# EasyEDA Pro project WearableGasDetect.eprj, board PCB1 (continued)
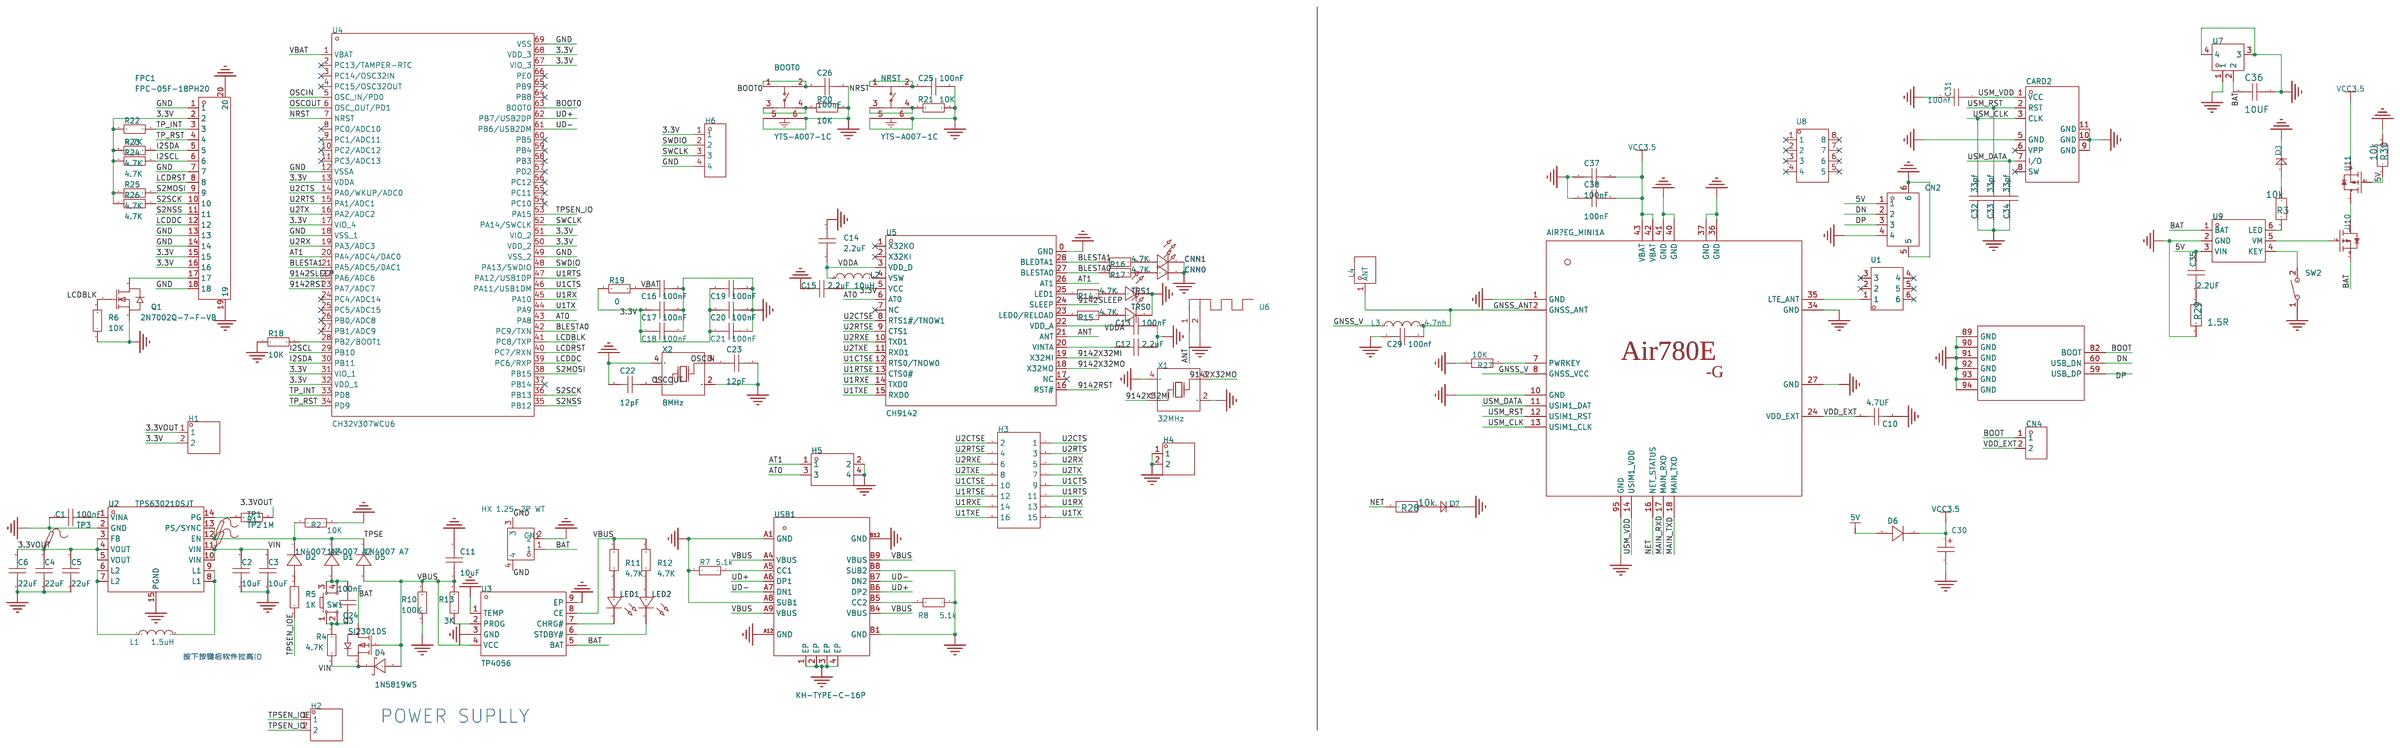
[diagram p0: schematic sheet]
## Footprints (pads in the part's own frame, mm; a bottom-side part is the same pattern mirrored in y, then rotated) (continued)
  rect 0.7x0.2 smd: 8(2,-1.2) 9(2,-0.8) 10(2,-0.4) 11(1.999,0) 12(2,0.4) 13(2,0.8) 14(2,1.2) 22(-2,1.2) 23(-2,0.8) 24(-2,0.4) 25(-2,0) 26(-2,-0.4) 27(-2,-0.8) 28(-2,-1.2)
QFN-68_L8.0-W8.0-P0.40-BL-EP6.7
  rect 0.2x0.8 smd: 1(-3.2,-4) 2(-2.8,-4) 3(-2.4,-4) 4(-2,-4) 5(-1.6,-4) 6(-1.2,-4) 7(-0.8,-4) 8(-0.4,-4) 9(0,-4) 10(0.4,-4) 11(0.8,-4) 12(1.2,-4) 13(1.6,-4) 14(2,-4) 15(2.4,-4) 16(2.8,-4) 17(3.2,-4) 35(3.2,4) 36(2.8,4) 37(2.4,4) 38(2,4) 39(1.6,4) 40(1.2,4) 41(0.8,4) 42(0.4,4) 43(0,4) 44(-0.4,4) 45(-0.8,4) 46(-1.2,4) 47(-1.6,4) 48(-2,4) 49(-2.4,4) 50(-2.8,4) 51(-3.2,4)
  rect 0.8x0.2 smd: 18(4,-3.2) 19(4,-2.8) 20(4,-2.4) 21(4,-2) 22(4,-1.6) 23(4,-1.2) 24(4,-0.8) 25(4,-0.4) 26(4,0) 27(4,0.4) 28(4,0.8) 29(4,1.2) 30(4,1.6) 31(4,2) 32(4,2.4) 33(4,2.8) 34(4,3.2) 52(-4,3.2) 53(-4,2.8) 54(-4,2.4) 55(-4,2) 56(-4,1.6) 57(-4,1.2) 58(-4,0.8) 59(-4,0.4) 60(-4,0) 61(-4,-0.4) 62(-4,-0.8) 63(-4,-1.2) 64(-4,-1.6) 65(-4,-2) 66(-4,-2.4) 67(-4,-2.8) 68(-4,-3.2)
  custom 6.65x6.65 smd: 69(0,0)
R0402
  rect 0.566x0.54 smd: 1(-0.433,0) 2(0.433,0)
R0603
  rect 0.806x0.864 smd: 1(-0.753,0) 2(0.753,0)
r0603
  rect 0.806x0.864 smd: 1(-0.753,0) 2(0.753,0)
SOD-123FL_L2.8-W1.8-LS3.7-RD
  rect 1.2x1.2 smd: 1(-1.6,0) 2(1.6,0)
SOD-123FL_L3.0-W1.8-LS3.7-RD
  rect 1.4x1.219 smd: 1(-1.6,0) 2(1.6,0)
SOD-323_L1.8-W1.3-LS2.5-RD
  rect 1x0.75 smd: 1(-1.173,0) 2(1.173,0)
SOIC-8_L4.9-W3.9-P1.27-LS6.0-BL
  oval 0.588x2.045 smd: 1(-1.905,-2.772) 2(-0.635,-2.772) 3(0.635,-2.772) 4(1.905,-2.772) 5(1.905,2.772) 6(0.635,2.772) 7(-0.635,2.772) 8(-1.905,2.772)
SOT-23-3_L2.9-W1.3-P1.90-LS2.4-BR
  rect 1.25x0.7 smd: 1(1,-0.95) 2(1,0.95) 3(-1,0)
SOT-23-3_L2.9-W1.4-P1.90-LS2.5-BR
  rect 1.07x0.6 smd: 1(1.035,-0.95) 2(1.035,0.95) 3(-1.035,0)
SOT-23-3_L2.9-W1.6-P1.90-LS2.8-BR
  rect 1.07x0.6 smd: 1(1.235,-0.95) 2(1.235,0.95) 3(-1.235,0)
SW-SMD_4P-L6.0-W6.0-P4.50-LS9.0-2
  rect 2.3x1.5 smd: 1(-4.55,2.25) 2(4.55,2.25) 3(-4.55,-2.25) 4(4.55,-2.25)
SW-SMD_6P-L3.4-W3.4-P2.00-LS4.0
  rect 1.1x0.7 smd: 1(-1.95,1) 2(1.95,1) 3(-1.95,-1) 4(1.95,-1)
  rect 0.7x0.25 smd: 5(0,1.625) 6(0,-1.625)
SW-SMD_L6.1-W3.6-LS7.9
  rect 1.5x1 smd: 1(-3.95,0) 2(3.95,0)
Test-Point-0.5mm
  round 0.5 smd: 1(0,0)
USB-C-SMD_KH-TYPE-C-16P
  oval 1x2 hole 0.6x1.7: 1(-4.32,1.765) 2(4.32,1.765)
  oval 1x1.8 hole 0.6x1.4: 3(-4.32,-2.415) 4(4.32,-2.415)
  rect 0.3x1.3 smd: A1(-3.35,2.415) A4(-2.55,2.415) A5(-1.25,2.415) A6(-0.25,2.415) A7(0.25,2.415) A8(1.25,2.415) A9(2.55,2.415) A12(3.35,2.415) B1(3.05,2.415) B4(2.25,2.415) B5(1.75,2.415) B6(0.75,2.415) B7(-0.75,2.415) B8(-1.75,2.415) B9(-2.25,2.415) B12(-3.05,2.415)
VSON-14_L4.0-W3.0-P0.50-BL-EP_TI_DSJ
  rect 0.25x0.7 smd: 1(-1.5,-1.45) 2(-1,-1.45) 3(-0.5,-1.45) 4(0,-1.45) 5(0.5,-1.45) 6(1,-1.45) 7(1.5,-1.45) 8(1.5,1.45) 9(1,1.45) 10(0.5,1.45) 11(0,1.45) 12(-0.5,1.45) 13(-1,1.45) 14(-1.5,1.45)
  custom 4.4x1.58 smd: 15(0,0)
通用蓝牙天线
  rect 0.5x0.5 smd: 1(-10.325,0)
  rect 0.9x0.5 smd: 2(-12.425,0)

## Nets
As in the schematic.

Pads without a net: CARD2 6 8; FPC2 1 2 3 4 5 6 7 8 9 10 11 12 13 14 15 16 17 18 19 20 21 22 23 24 25 26 27 28 29 30 31 32 33 34 35 36; U1 2 3 4 5 6; U4 2 3 4 8 9 10 11 24 25 26 27 37 54 55 56 57 58 59 60 64 65 66; U5 1 2 7 17; U8 1 2 3 4 5 6 7 8; U12 1 2 3 4 5 6 7 8

## Via types
v1: diameter 0.61, hole 0.305, Top Layer to Bottom Layer, 369 vias

## Routing (per net, layer and track width the routed paths; a pad name or vN(x,y) marks a point on that pad's centre or on a via; arc(x,y) is an arc through that point)
3.3V: length 128.2
  Top Layer w0.203: v1(26.08,20.3) 26.08,19.39 24.18,17.48 24.18,17.44 ; 33.58,17.44 33.58,16.3 ; 33.58,17.44 U4.31 ; 33.58,17.44 33.63,17.5 U4.32 ; 33.58,16.3 33.58,16.28 C20.1 33.69,15.84 v1(33.7,15.85) ; 33.58,16.3 33.25,15.97 33.14,15.97 ; 24.18,17.44 26.64,19.9 U4.13 ; 24.18,17.44 C18.1 ; FPC1.15 35.63,10.41 v1(35.93,10.71) 36.13,10.51 FPC1.16 ; C17.1 28.78,26.59 U4.67 28.73,25.55 v1(25.64,25.55) ; v1(25.64,26.79) 25.09,27.34 R19.1 ; U4.17 27.58,17.92 C19.1 27.04,16.81 v1(27.28,16.57) ; C21.1 36.92,25.25 36.94,25.23 ; C21.1 37.26,24.83 v1(37.26,24.43) ; C21.1 36.12,25.25 36.12,25.24 U4.51 U4.50 ; 28.88,10.84 29.13,10.59 FPC1.2 ; C15.2 49.77,33.57 49.2,34.14 48.31,34.14 47.38,35.08 U5.5
  Top Layer w0.381: H1.2 35.28,35.78 35.28,41.57 27.86,48.99 H6.1
  Top Layer w0.508: v1(37.01,33.63) 37.6,33.04 40.4,33.04 43.48,29.95 49.96,29.95 51.36,31.35 51.36,32.68 51.04,33 49.81,33 C15.2
  Bottom Layer w0.203: v1(36.63,33.95) 36.69,33.95 v1(37.01,33.63)
  Bottom Layer w0.508: v1(35.93,10.71) 35.86,10.77 v1(29.01,10.77) 28.37,11.41 28.37,15.54 28.31,15.54 ; 28.31,15.54 28.37,15.47 33.32,15.47 v1(33.7,15.85) ; 28.31,15.54 v1(27.28,16.57) 26.08,17.76 v1(26.08,20.3) 25.64,20.74 v1(25.64,25.55) v1(25.64,26.15) v1(25.64,26.79) 25.64,27.92 27.23,29.51 29.01,29.51 H1.2 ; v1(36.63,33.95) H1.2 ; H1.2 33.45,28.24 v1(37.26,24.43)
3.3VOUT: length 11.2
  Top Layer w0.203: R1.2 v1(19.1,33.76)
  Bottom Layer w0.203: v1(19.1,33.76) 19.92,32.94 28.18,32.94 v1(28.81,33.57)
GND: length 36.6
  Top Layer w0.127: FPC1.7 31.63,8.47 arc(31.64,8.41) 31.67,8.36 arc(31.73,8.07) 31.9,7.82 v1(31.93,7.79) ; 8.45,39.31 7.94,38.8 arc(7.78,38.69) 7.59,38.65 arc(7.43,38.62) USB1.B12 ; 8.45,39.31 v1(8.81,39.67) ; 8.45,39.31 arc(7.92,38.95) USB1.A1 ; v1(26.59,21.19) 26.59,20.98 arc(26.66,20.64) 26.85,20.36 27.42,20.36 arc(27.51,20.35) U4.12 ; FPC1.13 34.63,7.63 arc(34.65,7.51) v1(34.72,7.41) arc(35.02,7.86) 35.13,8.39 FPC1.14 ; USB1.A8 7.69,34.23 arc(8.87,34.46) R8.1 10.53,35.78 10.53,36.75 10.09,37.18 R7.2 arc(9.84,37.21) 9.78,37.23 USB1.B8 6.74,37.23 arc(6.09,37.1) v1(5.54,36.73) ; 7.29,32.13 9.38,32.13 arc(9.52,32.15) v1(9.63,32.23) arc(9.41,32.37) 9.15,32.43 USB1.B1 ; v1(31.04,16.62) 31.04,16.48 R18.1 ; U4.49 arc(34.1,23.6) 32.85,22.77 U4.69 28.94,18.86 arc(28.53,18.24) U4.18
  vias: v1(7.35,5.06) v1(7.4,3.65) v1(7.4,2.26) v1(7.4,0.67) v1(9.05,5.06) v1(9.1,3.65) v1(9.1,2.26) v1(9.1,0.67) v1(10.73,5.06) v1(10.77,3.65) v1(10.77,2.26) v1(10.77,0.67) v1(12.28,5.06) v1(12.33,3.65) v1(12.33,2.26) v1(12.33,0.67) v1(16.69,39.86) v1(17.32,39.86) v1(18.46,39.86) v1(19.1,39.86) v1(19.42,52.37) v1(19.46,50.95) v1(19.46,49.56) v1(19.46,47.98) v1(20.94,40.43) v1(21,34.59) v1(21.12,52.37) v1(21.16,50.95) v1(21.16,49.56) v1(21.16,47.98) v1(21.26,39.86) v1(21.32,34.02) v1(21.58,40.43) v1(21.64,34.59) v1(21.89,39.86) v1(21.96,34.02) v1(22.21,40.43) v1(22.27,34.59) v1(22.53,39.86) v1(22.59,34.02) v1(22.79,52.37) v1(22.84,50.95) v1(22.84,49.56) v1(22.84,47.98) v1(22.85,40.43) v1(22.91,34.59) v1(23.92,14.39) v1(24.34,52.37) v1(24.39,50.95) v1(24.39,49.56) v1(24.39,47.98) v1(25,39.41) v1(25.64,39.41) v1(25.96,9.5) v1(26.47,15.72) v1(26.78,39.41) v1(26.94,6.82) v1(27.08,9.5) v1(27.42,45.64) v1(27.42,39.41) v1(27.46,44.22) v1(27.46,42.83) v1(27.46,41.25) v1(28.56,39.41) v1(29.12,45.64) v1(29.07,23.73) v1(29.11,22.32) v1(29.11,20.92) v1(29.11,19.34) v1(29.07,7.92) v1(29.07,6.89) v1(29.17,44.22) v1(29.17,42.83) v1(29.17,41.25) v1(29.2,39.41) v1(30.77,23.73) v1(30.82,22.32) v1(30.82,20.92) v1(30.82,19.34) v1(30.84,44.22) v1(30.84,42.83) v1(30.84,41.25) v1(31.93,5.24) v1(32.39,42.83) v1(32.39,41.25) v1(32.44,23.73) v1(32.49,22.32) v1(32.49,20.92) v1(32.49,19.34) v1(32.62,26.9) v1(33.14,13.84) v1(34,23.73) v1(34.04,22.32) v1(34.04,20.92) v1(34.04,19.34) v1(35.98,7.41) v1(36.9,12.11) v1(36.95,7.41) v1(37.96,25.25) v1(38.09,9.69) v1(38.21,38.27) v1(38.21,36.84) v1(38.21,8.74) v1(38.78,53.1) v1(38.78,52.25) v1(38.78,51.4) v1(38.78,50.55) v1(38.78,49.7) v1(38.78,48.85) v1(38.78,48) v1(38.78,47.15) v1(38.78,46.3) v1(38.78,45.38) v1(38.75,34.9) v1(39.29,44.81) v1(39.38,9.69) v1(39.48,53.48) v1(39.48,52.63) v1(39.48,51.78) v1(39.48,50.93) v1(39.48,50.08) v1(39.48,49.23) v1(39.48,48.38) v1(39.48,47.53) v1(39.48,46.68) v1(39.58,45.65) v1(39.58,8.84) v1(40.12,53.15) v1(40.12,52.3) v1(40.12,51.45) v1(40.12,50.6) v1(40.12,49.75) v1(40.12,48.91) v1(40.12,48.06) v1(40.12,47.21) v1(40.12,46.36) v1(40.15,45.01) v1(40.53,45.65) v1(40.63,30.97) v1(40.67,9.69) v1(41.01,8.84) v1(41.07,46.36) v1(41.1,45.01) v1(41.32,30.4) v1(41.42,45.62) v1(41.96,46.33) v1(41.99,44.99) v1(42.02,29.82) v1(42.37,45.65) v1(42.91,46.36) v1(42.94,45.01) v1(43.32,45.65) v1(43.86,46.36) v1(43.9,45.01) v1(44.69,46.14) v1(44.69,45.29) v1(44.69,44.44) v1(44.69,43.6) v1(44.69,42.75) v1(44.69,41.9) v1(44.69,41.05) v1(44.69,40.2) v1(45.45,30.97) v1(46.21,38.4) v1(46.2,37.59) v1(46.21,36.75) v1(46.4,46.48) v1(46.4,45.82) v1(46.4,44.97) v1(46.4,44.12) v1(46.4,43.27) v1(46.4,42.42) v1(46.4,41.57) v1(46.98,38.4) v1(46.98,37.59) v1(46.98,36.75) v1(47.29,46.33) v1(47.33,45.06) v1(47.83,45.7) v1(47.83,38.4) v1(47.85,37.59) v1(47.86,36.75) v1(48.25,46.33) v1(48.28,45.06) v1(48.79,45.7) v1(49.2,46.33) v1(49.2,10.2) v1(49.23,45.06) v1(49.24,8.79) v1(49.24,7.4) v1(49.24,5.82) v1(49.74,45.7) v1(50.15,46.33) v1(50.18,45.06) v1(50.69,45.7) v1(50.9,10.2) v1(50.95,8.79) v1(50.95,7.4) v1(50.95,5.82) v1(51.1,46.33) v1(51.14,45.06) v1(51.64,45.7) v1(52.06,46.33) v1(52.09,45.06) v1(52.6,45.7) v1(52.57,10.2) v1(52.62,8.79) v1(52.62,7.4) v1(52.62,5.82) v1(53.01,46.33) v1(53.04,45.06) v1(53.55,45.7) v1(53.96,46.33) v1(53.99,45.06) v1(54.13,10.2) v1(54.17,8.79) v1(54.17,7.4) v1(54.17,5.82) v1(54.5,45.7) v1(54.91,46.33) v1(54.95,45.06) v1(55.45,45.7) v1(55.87,46.33) v1(55.9,45.06) v1(55.93,10.08) v1(55.97,8.66) v1(55.97,7.27) v1(55.97,5.69) v1(56.41,45.7) v1(56.82,46.33) v1(56.85,45.06) v1(57.36,45.7) v1(57.71,43.16) v1(57.63,10.08) v1(57.68,8.66) v1(57.68,7.27) v1(57.68,5.69) v1(57.77,46.33) v1(57.8,45.06) v1(57.75,41.75) v1(57.75,40.36) v1(57.75,38.77) v1(58.31,45.7) v1(58.79,46.33) v1(58.82,45.06) v1(59.3,10.08) v1(59.33,45.7) v1(59.41,43.16) v1(59.35,8.66) v1(59.35,7.27) v1(59.35,5.69) v1(59.45,41.75) v1(59.45,40.36) v1(59.45,38.77) v1(59.74,46.33) v1(59.77,45.06) v1(60.28,45.7) v1(60.69,53.13) v1(60.69,52.28) v1(60.69,51.43) v1(60.69,50.58) v1(60.69,49.73) v1(60.69,48.88) v1(60.69,48.03) v1(60.69,47.18) v1(60.69,46.33) v1(60.69,46.33) v1(60.72,45.06) v1(60.72,45.06) v1(60.86,10.08) v1(60.9,8.66) v1(60.9,7.27) v1(60.9,5.69) v1(61.08,43.16) v1(61.13,41.75) v1(61.13,40.36) v1(61.13,38.77) v1(61.23,45.7) v1(61.23,45.7) v1(61.39,53.64) v1(61.39,52.79) v1(61.39,51.94) v1(61.39,51.09) v1(61.39,50.24) v1(61.39,49.39) v1(61.39,48.54) v1(61.39,47.69) v1(61.39,46.84) v1(61.77,45) v1(62.09,53.19) v1(62.09,52.34) v1(62.09,51.49) v1(62.09,50.64) v1(62.09,49.79) v1(62.09,48.95) v1(62.09,48.1) v1(62.09,47.25) v1(62.09,46.4) v1(62.15,45.64) v1(62.6,45) v1(62.64,43.16) v1(62.68,41.75) v1(62.68,40.36) v1(62.68,38.77) v1(62.79,53.64) v1(62.79,52.79) v1(62.79,51.94) v1(62.79,51.09) v1(62.79,50.24) v1(62.79,49.39) v1(62.79,48.54) v1(62.79,47.69) v1(62.79,46.84) v1(62.85,45.95)
VBAT: length 4.2
  Top Layer w0.203: 26.18,24.39 26.77,24.39 27.08,24.7 U4.1 ; 26.18,24.39 25.64,24.93 25.14,24.93 R19.2 ; 26.18,24.39 C16.1
VBUS: length 80.6
  Top Layer w0.203: USB1.B4 6.5,33.23 6.11,33.62 5.14,33.62 4.38,34.38 4.38,36.89 5.02,37.52 6.34,37.52 6.54,37.73 USB1.B9
  Top Layer w0.305: 11.67,40.94 11.67,40.77 11.54,40.64 ; 11.67,40.94 16.75,40.94 17.08,41.27 17.08,43.9 15.88,45.11 15.88,45.64 ; 11.67,40.94 11.67,43.03 11.03,43.67 11.03,49.7 12.18,50.84 ; 11.67,40.94 11.42,40.94 ; 11.54,40.64 16.87,40.64 17.38,41.15 17.38,44.03 16.18,45.23 16.18,45.64 ; 11.54,40.64 8.63,37.73 ; USB1.B9 8.63,37.73 ; 8.63,37.73 8.63,37.9 8.5,38.03 ; 8.5,38.03 USB1.A4 ; 8.5,38.03 11.42,40.94 ; 11.69,37.42 11.46,37.19 11.46,33.36 11.02,32.93 USB1.A9 ; 11.48,37.63 11.16,37.32 11.16,33.49 10.9,33.23 USB1.B4 ; 11.42,40.94 11.42,42.93 10.78,43.56 10.78,49.8 12,51.02
VDDA: length 26.2
  Top Layer w0.203: 43.58,39.69 C14.1 ; 43.58,39.69 44.44,38.83 U5.22 ; 43.58,39.69 43.44,39.54 37.77,39.54 37.39,39.16 37.39,34.14 37.89,33.63 43.2,33.63 C13.1 45.53,32.97 L2.1 45.95,33.87 46.58,34.5 U5.3
9142RST: length 94.3
  Top Layer w0.203: U5.16 47.78,40.09 47.93,40.24 50.57,40.24 53.06,37.75 54.81,37.75 55.88,36.69 55.88,33.62 62.1,27.4 62.1,20.05 58.52,16.48 45.89,16.48 43.5,14.09 43.5,6.02 40.69,3.22 26.41,3.22 24.42,5.2 24.42,10.02 28.23,13.82 28.23,14.63 30.38,16.78 U4.23
9142SLEEP: length 109.8
  Top Layer w0.203: v1(43.23,38.27) 43.46,38.03 U5.24 ; U4.22 29.98,16.81 27.92,14.76 27.92,13.95 24.11,10.13 24.11,5.07 26.28,2.9 40.82,2.9 43.81,5.89 43.81,13.96 46.02,16.16 58.65,16.16 62.42,19.92 62.42,27.53 56.19,33.76 56.19,36.8 54.66,38.33 v1(53.26,38.33)
  Bottom Layer w0.203: v1(53.26,38.33) 53.26,37 52.09,35.83 48.11,35.83 47.42,35.15 44.42,35.15 43.99,34.71 43.99,34.43 43.42,33.86 42.56,33.86 42.32,34.1 42.32,35.07 43.93,36.68 43.93,37.7 43.36,38.27 v1(43.23,38.27)
9142X32MI: length 4.4
  Top Layer w0.203: U5.19 46.58,40.16 47.37,40.95 49.1,40.95 49.3,41.15 49.3,41.93
9142X32MO: length 7.4
  Top Layer w0.203: U5.18 46.98,40.11 47.51,40.64 49.92,40.64 50.4,41.13 50.4,42.66 X1.3
ANT: length 7.8
  Top Layer w0.127: 45.77,39.35 45.55,39.58 arc(45.46,39.71) 45.42,39.87
  Top Layer w0.508: U6.1 45.6,39.91 arc(45.62,39.84) 45.66,39.78
AT0: length 73.9
  Top Layer w0.203: v1(48.94,34.97) 47.99,34.97 47.78,35.18 U5.6 ; v1(54.79,36.56) 54.79,35.97 55.25,35.51 55.25,33.36 61.47,27.14 61.47,20.32 58.28,17.12 43.04,17.12 40.88,19.28 39.1,19.28 37.64,20.74 37.2,20.74 36.44,21.5 U4.43
  Bottom Layer w0.203: v1(48.94,34.97) 50.47,34.97 ; 50.47,34.97 53.2,34.97 v1(54.79,36.56) ; 50.47,34.97 51.48,33.95 51.48,32.8 47.8,29.11 41.08,29.11 H5.3
AT1: length 132.5
  Top Layer w0.203: v1(43.23,36.81) 43.65,37.23 U5.26 ; v1(52.12,39.48) 54.38,39.48 56.82,37.04 56.82,34.02 63.04,27.79 63.04,19.66 58.91,15.54 46.28,15.54 44.44,13.7 44.44,5.63 41.08,2.27 26.02,2.27 23.48,4.81 23.48,10.41 27.29,14.21 27.29,15.03 29.18,16.92 U4.20
  Bottom Layer w0.203: v1(43.23,36.81) 41.9,36.81 37.58,32.49 37.58,30.08 H5.1 47.93,28.81 55.48,36.36 55.48,38.46 54.47,39.48 v1(52.12,39.48)
BAT: length 13.7
  Bottom Layer w0.762: v1(12.44,38.82) 12.43,38.83 12.43,40.56 12.05,40.94 12.05,45.95 11.36,46.64 v1(8.12,46.64) v1(7.14,46.64) v1(6.58,46.64) v1(5.95,46.64)
  vias: v1(12.18,45.2) v1(12.18,44.39) v1(12.44,39.54)
BLESTA0: length 77
  Top Layer w0.203: v1(44.75,34.59) 44.13,33.96 38.26,33.96 37.88,34.35 37.88,35.15 38.26,35.54 41.65,35.54 41.94,35.83 41.94,36.2 42.39,35.75 43.25,35.75 44.33,36.83 U5.27 ; v1(54.21,37.19) 54.94,37.19 55.56,36.57 55.56,33.49 61.78,27.27 61.78,20.19 58.41,16.81 42.91,16.81 40.75,18.97 38.97,18.97 37.51,20.43 37.07,20.43 36.4,21.1 U4.42
  Bottom Layer w0.203: v1(44.75,34.59) 47.29,34.59 48.23,35.53 52.55,35.53 v1(54.21,37.19)
BLESTA1: length 108.6
  Top Layer w0.203: v1(43.04,34.52) 42.33,34.52 R16.1 42.49,35.44 43.51,35.44 44.5,36.43 U5.28 ; v1(52.69,38.9) 54.52,38.9 56.51,36.91 56.51,33.89 62.73,27.66 62.73,19.79 58.79,15.84 46.15,15.84 44.13,13.83 44.13,5.76 40.95,2.58 26.15,2.58 23.79,4.94 23.79,10.24 27.62,14.08 27.62,14.89 29.58,16.85 U4.21
  Bottom Layer w0.203: v1(52.69,38.9) 52.69,36.86 51.97,36.14 47.97,36.14 47.28,35.45 44.3,35.45 43.37,34.52 v1(43.04,34.52)
BOOT0: length 49.1
  Top Layer w0.203: 28.56,29.96 30.38,28.15 U4.63 ; BOOT0.1 BOOT0.2 7.43,8.66 C26.2 7.48,8.77 7.48,12.43 8.51,13.45 14.65,13.45 17.25,16.05 17.25,27.03 20.18,29.96 28.56,29.96
I2SCL: length 27.9
  Top Layer w0.203: FPC1.6 31.1,9.37 31.1,6.32 29.14,4.36 25.76,4.36 24.75,5.37 24.75,9.89 26.71,11.85 28.94,11.85 30.72,13.63 31.48,13.63 31.93,14.08 31.93,16.14 32.78,17 U4.29
I2SDA: length 26.8
  Top Layer w0.203: FPC1.5 30.66,9.37 30.66,6.33 28.99,4.67 25.91,4.67 25.07,5.5 25.07,9.76 26.85,11.54 29.07,11.54 30.85,13.31 31.61,13.31 32.24,13.95 32.24,15.98 33.18,16.92 U4.30
LCDBLK: length 12.9
  Top Layer w0.203: R6.2 40.15,12.99 39.67,13.46 ; 39.67,13.46 Q1.1 ; 39.67,13.46 v1(39.67,14.71) ; U4.41 36.29,20.7 36.88,20.11 37.4,20.11 38.86,18.65 39.86,18.65 v1(41.07,17.44)
  Bottom Layer w0.203: v1(39.67,14.71) 39.67,16.04 v1(41.07,17.44)
LCDDC: length 16.2
  Top Layer w0.203: U4.39 36.2,19.9 36.63,19.47 37.13,19.47 39.23,17.38 v1(40.05,17.38) ; FPC1.12 34.13,10.56 36.68,13.11 36.68,14.39 37.06,14.77 37.45,14.77 v1(38.09,15.41)
  Bottom Layer w0.203: v1(38.09,15.41) v1(40.05,17.38)
LCDRST: length 17.5
  Top Layer w0.203: v1(37.26,15.41) 36.37,14.52 36.37,13.24 33.97,10.84 32.56,10.84 32.13,10.41 FPC1.8 ; v1(39.55,18.08) 38.98,18.08 37.26,19.79 36.75,19.79 36.25,20.3 U4.40
  Bottom Layer w0.203: v1(37.26,15.41) 39.55,17.7 v1(39.55,18.08)
NRST: length 27.7
  Top Layer w0.203: U4.7 26.88,22.3 25.07,20.49 25.07,19.03 22.85,16.81 22.85,11.99 18.83,7.98 15.74,7.98 15.54,8.18 C25.2 15.47,8.66 NRST.2 NRST.1
OSCIN: length 8.5
  Top Layer w0.203: U4.5 26.59,23.1 24.87,21.38 23.29,21.38 X2.3 22.26,22.68 C23.1
OSCOUT: length 6.8
  Top Layer w0.203: U4.6 26.64,22.7 24.29,20.34 X2.1 23.82,18.95 C22.2
S2MOSI: length 33.7
  Top Layer w0.203: FPC1.9 32.62,9.39 32.62,6.35 35.39,3.58 40.46,3.58 43.14,6.25 43.14,14.53 41.43,16.24 39.78,16.24 36.92,19.09 36.5,19.09 36.09,19.5 U4.38
S2NSS: length 29.5
  Top Layer w0.203: U4.35 36.59,18.3 39.45,15.44 41.1,15.44 42.34,14.2 42.34,6.58 40.13,4.38 35.72,4.38 33.64,6.46 33.64,9.38 FPC1.11
S2SCK: length 31.6
  Top Layer w0.203: FPC1.10 33.11,9.38 33.11,6.42 35.57,3.96 40.28,3.96 42.74,6.42 42.74,14.37 41.25,15.85 39.6,15.85 36.76,18.7 U4.36
SWCLK: length 33.8
  Top Layer w0.203: U4.52 34.78,26.54 33.83,27.49 33.83,31.73 35.67,33.57 35.67,41.95 29.13,48.49 29.13,50.72 29.89,51.48 31.61,51.48 H6.3
SWDIO: length 36.1
  Top Layer w0.203: H6.2 30.4,47.65 35.98,42.08 35.98,33.44 34.14,31.6 34.14,27.61 35.42,26.33 38.4,26.33 38.66,26.08 38.66,24.05 38.11,23.5 U4.48
TP_INT: length 11.6
  Top Layer w0.203: U4.33 34.38,13.67 33.7,13 31.05,13 29.64,11.59 29.64,9.41 FPC1.3
TP_RST: length 11.6
  Top Layer w0.203: U4.34 34.78,13.63 33.84,12.69 31.18,12.69 30.15,11.66 30.15,9.41 FPC1.4
TPSE: length 14.8
  Top Layer w0.203: D1.1 D2.1 D5.1 14.53,33.39 14.53,34.14 14.97,34.59 15.86,34.59 ; 15.86,34.59 16.8,35.53 R2.1 17.83,35.98 18.06,36.22 U2.13 20.48,36.72 ; 15.86,34.59 16.75,33.69 TP1.1
TPSEN_IO: length 30.9
  Top Layer w0.203: U4.53 34.38,26.51 32.65,28.24 31.6,28.24 28.95,30.89 19.79,30.89 16.32,27.42 16.32,25.06 16.3,25.06 H2.2
TPSEN_IOE: length 9
  Top Layer w0.203: v1(8.37,28.74) 8.37,28.82 R5.2
  Bottom Layer w0.203: H2.1 11.92,25.19 v1(8.37,28.74)
U1CTS: length 28.3
  Top Layer w0.203: H3.9 53.64,25.63 55.67,25.63 56.18,25.13 56.18,23.6 53.74,21.16 38.99,21.16 37.44,22.71 35.59,22.71 U4.46
U1CTSE: length 14.6
  Top Layer w0.203: H3.10 52.37,28.11 53.67,29.41 53.67,34.99 50.62,38.03 U5.12
U1RTS: length 21.1
  Top Layer w0.203: U4.47 35.59,23.11 37.61,23.11 39.16,21.56 52.11,21.56 H3.11
U1RTSE: length 15.1
  Top Layer w0.203: H3.12 54.07,27.75 54.07,35.15 50.79,38.43 U5.13
U1RX: length 25.2
  Top Layer w0.203: 57.45,24.36 57.45,22.27 55.95,20.76 38.83,20.76 37.28,22.31 35.59,22.31 U4.45
U1RXE: length 16.6
  Top Layer w0.203: 57.45,26.9 54.47,29.89 54.47,35.32 50.95,38.83 U5.14
U1TX: length 26.8
  Top Layer w0.203: U4.44 35.59,21.91 37.11,21.91 38.66,20.36 56.11,20.36 59.99,24.24 59.99,24.36
U1TXE: length 19.1
  Top Layer w0.203: 59.99,26.9 54.85,32.05 54.85,35.48 51.1,39.22 49.64,39.22 49.23,39.63 U5.15
U2CTS: length 70
  Top Layer w0.203: v1(48.63,13.38) 47.04,13.38 45.71,12.04 45.71,5.11 41.6,1.01 25.5,1.01 22.21,4.29 22.21,10.93 25,13.72 25,17.57 26.93,19.5 U4.14
  Bottom Layer w0.203: v1(48.63,13.38) 46.4,13.38 45.64,14.14 45.64,15.54 45.96,15.85 45.96,20.62 H3.1
U2CTSE: length 19
  Top Layer w0.203: H3.2 44.63,29.32 50.72,29.32 52.07,30.66 52.07,34.33 49.96,36.43 U5.8
U2RTS: length 66
  Top Layer w0.203: v1(47.93,13.95) 47.16,13.95 45.39,12.18 45.39,5.24 41.47,1.33 25.63,1.33 22.53,4.42 22.53,10.8 25.32,13.59 25.32,17.44 26.98,19.1 U4.15
  Bottom Layer w0.203: v1(47.93,13.95) 46.47,13.95 45.96,14.46 45.96,15.35 46.34,15.73 46.34,22.78 H3.3
U2RTSE: length 17.6
  Top Layer w0.203: H3.4 46.85,29 50.86,29 52.47,30.6 52.47,34.49 50.13,36.83 U5.9
U2RX: length 59.2
  Top Layer w0.203: v1(46.53,14.9) 46.53,14.39 44.75,12.62 44.75,5.5 41.21,1.96 25.89,1.96 23.17,4.68 23.17,10.54 26.97,14.34 26.97,15.16 28.78,16.96 U4.19
  Bottom Layer w0.203: v1(46.53,14.9) 46.73,15.1 46.73,23.8 H3.5
U2RXE: length 16.2
  Top Layer w0.203: U5.10 50.29,37.23 52.87,34.66 52.87,30.57 50.89,28.59 48.83,28.59 47.29,27.06 H3.6
U2TX: length 62.5
  Top Layer w0.203: v1(47.29,14.52) 47.28,14.52 45.07,12.31 45.07,5.37 41.34,1.64 25.76,1.64 22.85,4.55 22.85,10.67 25.64,13.46 25.64,17.33 27.01,18.7 U4.16
  Bottom Layer w0.203: 49.83,24.36 47.09,21.62 47.09,15.61 47.29,15.41 v1(47.29,14.52)
U2TXE: length 14.8
  Top Layer w0.203: 49.83,26.9 53.27,30.34 53.27,34.82 50.46,37.63 U5.11
UD+: length 76
  Top Layer w0.203: 30.78,25.51 30.78,28.17 28.69,30.27 20.05,30.27 16.94,27.16 16.94,16.17 14.53,13.76 1.63,13.76 0.62,14.77 0.62,26.84 4.49,30.72 4.49,31.98 4.11,32.36 v1(4.11,33)
  Top Layer w0.305: USB1.A6 8.12,35.73 8.37,35.48 8.37,35.04 8.06,34.73 USB1.B6 5.9,34.73 v1(5.89,34.71)
  Bottom Layer w0.305: v1(4.11,33) 4.11,35.16 4.46,35.51 5.1,35.51 v1(5.89,34.71)
UD-: length 73.8
  Top Layer w0.203: U4.61 31.16,25.51 31.16,28.24 28.82,30.59 19.92,30.59 16.62,27.29 16.62,16.3 14.4,14.08 1.76,14.08 0.92,14.92 0.92,26.7 4.81,30.59 4.81,31.98 5,32.17 v1(5,33.06)
  Top Layer w0.305: USB1.A7 7.29,35.22 6.4,35.22 6.21,35.41 6.21,35.71 ; 6.21,35.71 6.21,36.05 6.39,36.23 USB1.B7 ; 6.21,35.71 6.19,35.73 5.89,35.73 v1(4.94,34.78)
  Bottom Layer w0.305: v1(4.94,34.78) 5,34.71 v1(5,33.06)
$1N2228: length 1.5
  Top Layer w0.203: R1.1 19.29,35.72 U2.14
$1N2253: length 2.2
  Top Layer w0.203: U2.1 23.81,35.72 24.5,35.03 C1.2
$1N4933: length 3.6
  Top Layer w0.203: FPC1.17 36.63,10.52 37.2,11.09 38.42,11.09 Q1.3
$1N5483: length 2.8
  Top Layer w0.305: R8.2 9.34,33.73 USB1.B5
$1N5485: length 2.8
  Top Layer w0.305: R7.1 9.47,36.31 9.06,36.73 USB1.A5
$1N6205: length 1.6
  Top Layer w0.254: R5.1 11.33,31.08 D2.2
$1N7410: length 2.4
  Top Layer w0.254: LED1.1 13.73,43.77 13.7,43.79 14.72,44.81 U3.7
$1N7413: length 4.5
  Top Layer w0.254: LED2.1 13.07,41.89 12.69,42.27 12.69,43.67 13.45,44.43 U3.6
$1N7423: length 1.5
  Top Layer w0.254: LED1.2 16.28,43.25 R11.2
$1N7425: length 1.5
  Top Layer w0.254: LED2.2 16.31,41.89
$1N7557: length 1.6
  Top Layer w0.254: R13.1 14.72,52.55 U3.2
$1N9478: length 2.1
  Top Layer w0.203: U4.28 32.38,17.03 31.28,15.93 R18.2
$1N10386: length 3.1
  Top Layer w0.203: R14.1 42.07,37.63 U5.25
$1N10412: length 3.2
  Top Layer w0.203: R15.1 43.8,38.84 44.21,38.43 U5.23
$1N10463: length 1.3
  Top Layer w0.203: TRS0.2 R15.2
$1N10490: length 1.3
  Top Layer w0.203: TRS1.2 R14.2
$1N10629: length 1.3
  Top Layer w0.203: CNN1.2 R16.2
$1N10680: length 1.3
  Top Layer w0.203: 41.08,36.2 41.05,36.17 CNN0.2
$1N10807: length 2.3
  Top Layer w0.203: 47.29,41.47 46.18,40.35 U5.20
$1N11164: length 3.5
  Top Layer w0.203: L2.2 47.88,33.62 46.97,34.52 U5.4
$1N14303: length 18.2
  Top Layer w0.254: SW1.4 5.04,27.13 C24.2 ; SW1.4 10.13,28.81 D1.2 ; SW1.4 SW1.3
$1N14308: length 33.4
  Top Layer w0.254: SW1.1 v1(2.24,25.42) 3.95,27.13 3.95,27.79 ; R4.1 15.1,39.54 15.16,39.6
  Bottom Layer w0.254: v1(15.1,39.6) 14.08,39.6 8.3,33.82 8.3,31.12 2.6,25.42 v1(2.24,25.42)
$1N19058: length 5.5
  Top Layer w0.203: R21.1 15.35,6.66 NRST.4 NRST.3
$1N19067: length 5.6
  Top Layer w0.203: 7.58,6.45 7.36,6.66 BOOT0.4 BOOT0.3

## Copper pours and planes (outline as drawn; the poured copper is in the pictures)
3.3VOUT on Top Layer: 23.03,37.84 31.86,37.84 31.86,33 23.03,33
GND on Top Layer: 19.92,40.75 24.12,40.75 24.12,33.19 19.92,33.19
GND on Top Layer: 42.62,46.91 44.31,46.91 44.31,46.21 42.62,46.21
GND on Top Layer: 22.21,36.36 27.54,36.36 27.54,33.82 22.21,33.82
GND on Top Layer: 0,54.26 64,54.26 64,0 0,0
GND on Bottom Layer: 0,54.26 64,54.26 64,0 0,0
VBUS on Top Layer: 9.32,53.1 13.57,53.1 13.57,49.76 9.32,49.76
VIN on Top Layer: 12.69,38.21 20.83,38.21 20.83,34.85 12.69,34.85
BAT on Top Layer: 11.61,45.83 12.69,45.83 12.69,44.05 11.61,44.05
BAT on Top Layer: 11.76,40.11 13,40.11 13,38.48 11.76,38.48
BAT on Top Layer: 5.68,47.03 8.56,47.03 8.56,46.26 5.68,46.26
$1N1613 on Top Layer: 23.03,45.95 25.77,45.95 25.77,38.08 23.03,38.08
$1N1618 on Top Layer: 18.27,45.95 20.83,45.95 20.83,38.08 18.27,38.08

Small or netless copper shapes (teardrops, artwork), in the pictures only: 260 on Top Layer, 46 on Bottom Layer

## Text on the board
Top Silkscreen Layer: TPSEN-IO | V SWDIO SWCLK G | POWER-IC | GND | AT1 | AT0 | USART2 | CTS RTS RX TX | USART1 | -+ | <-->
